# EasyEDA Pro project ProPrj_Starcat_FOC双路矢量控制器_2024-11-11.epro, schematic 14位磁编码_2
Create Date: 2024-03-02; Page Name: P1; Project Name: Starcat_FOC双路矢量控制器; Schematic Name: 14位磁编码; Update Date: 2024-03-02; Company: 嘉立创EDA; Page Size: A4; Version: V1.0
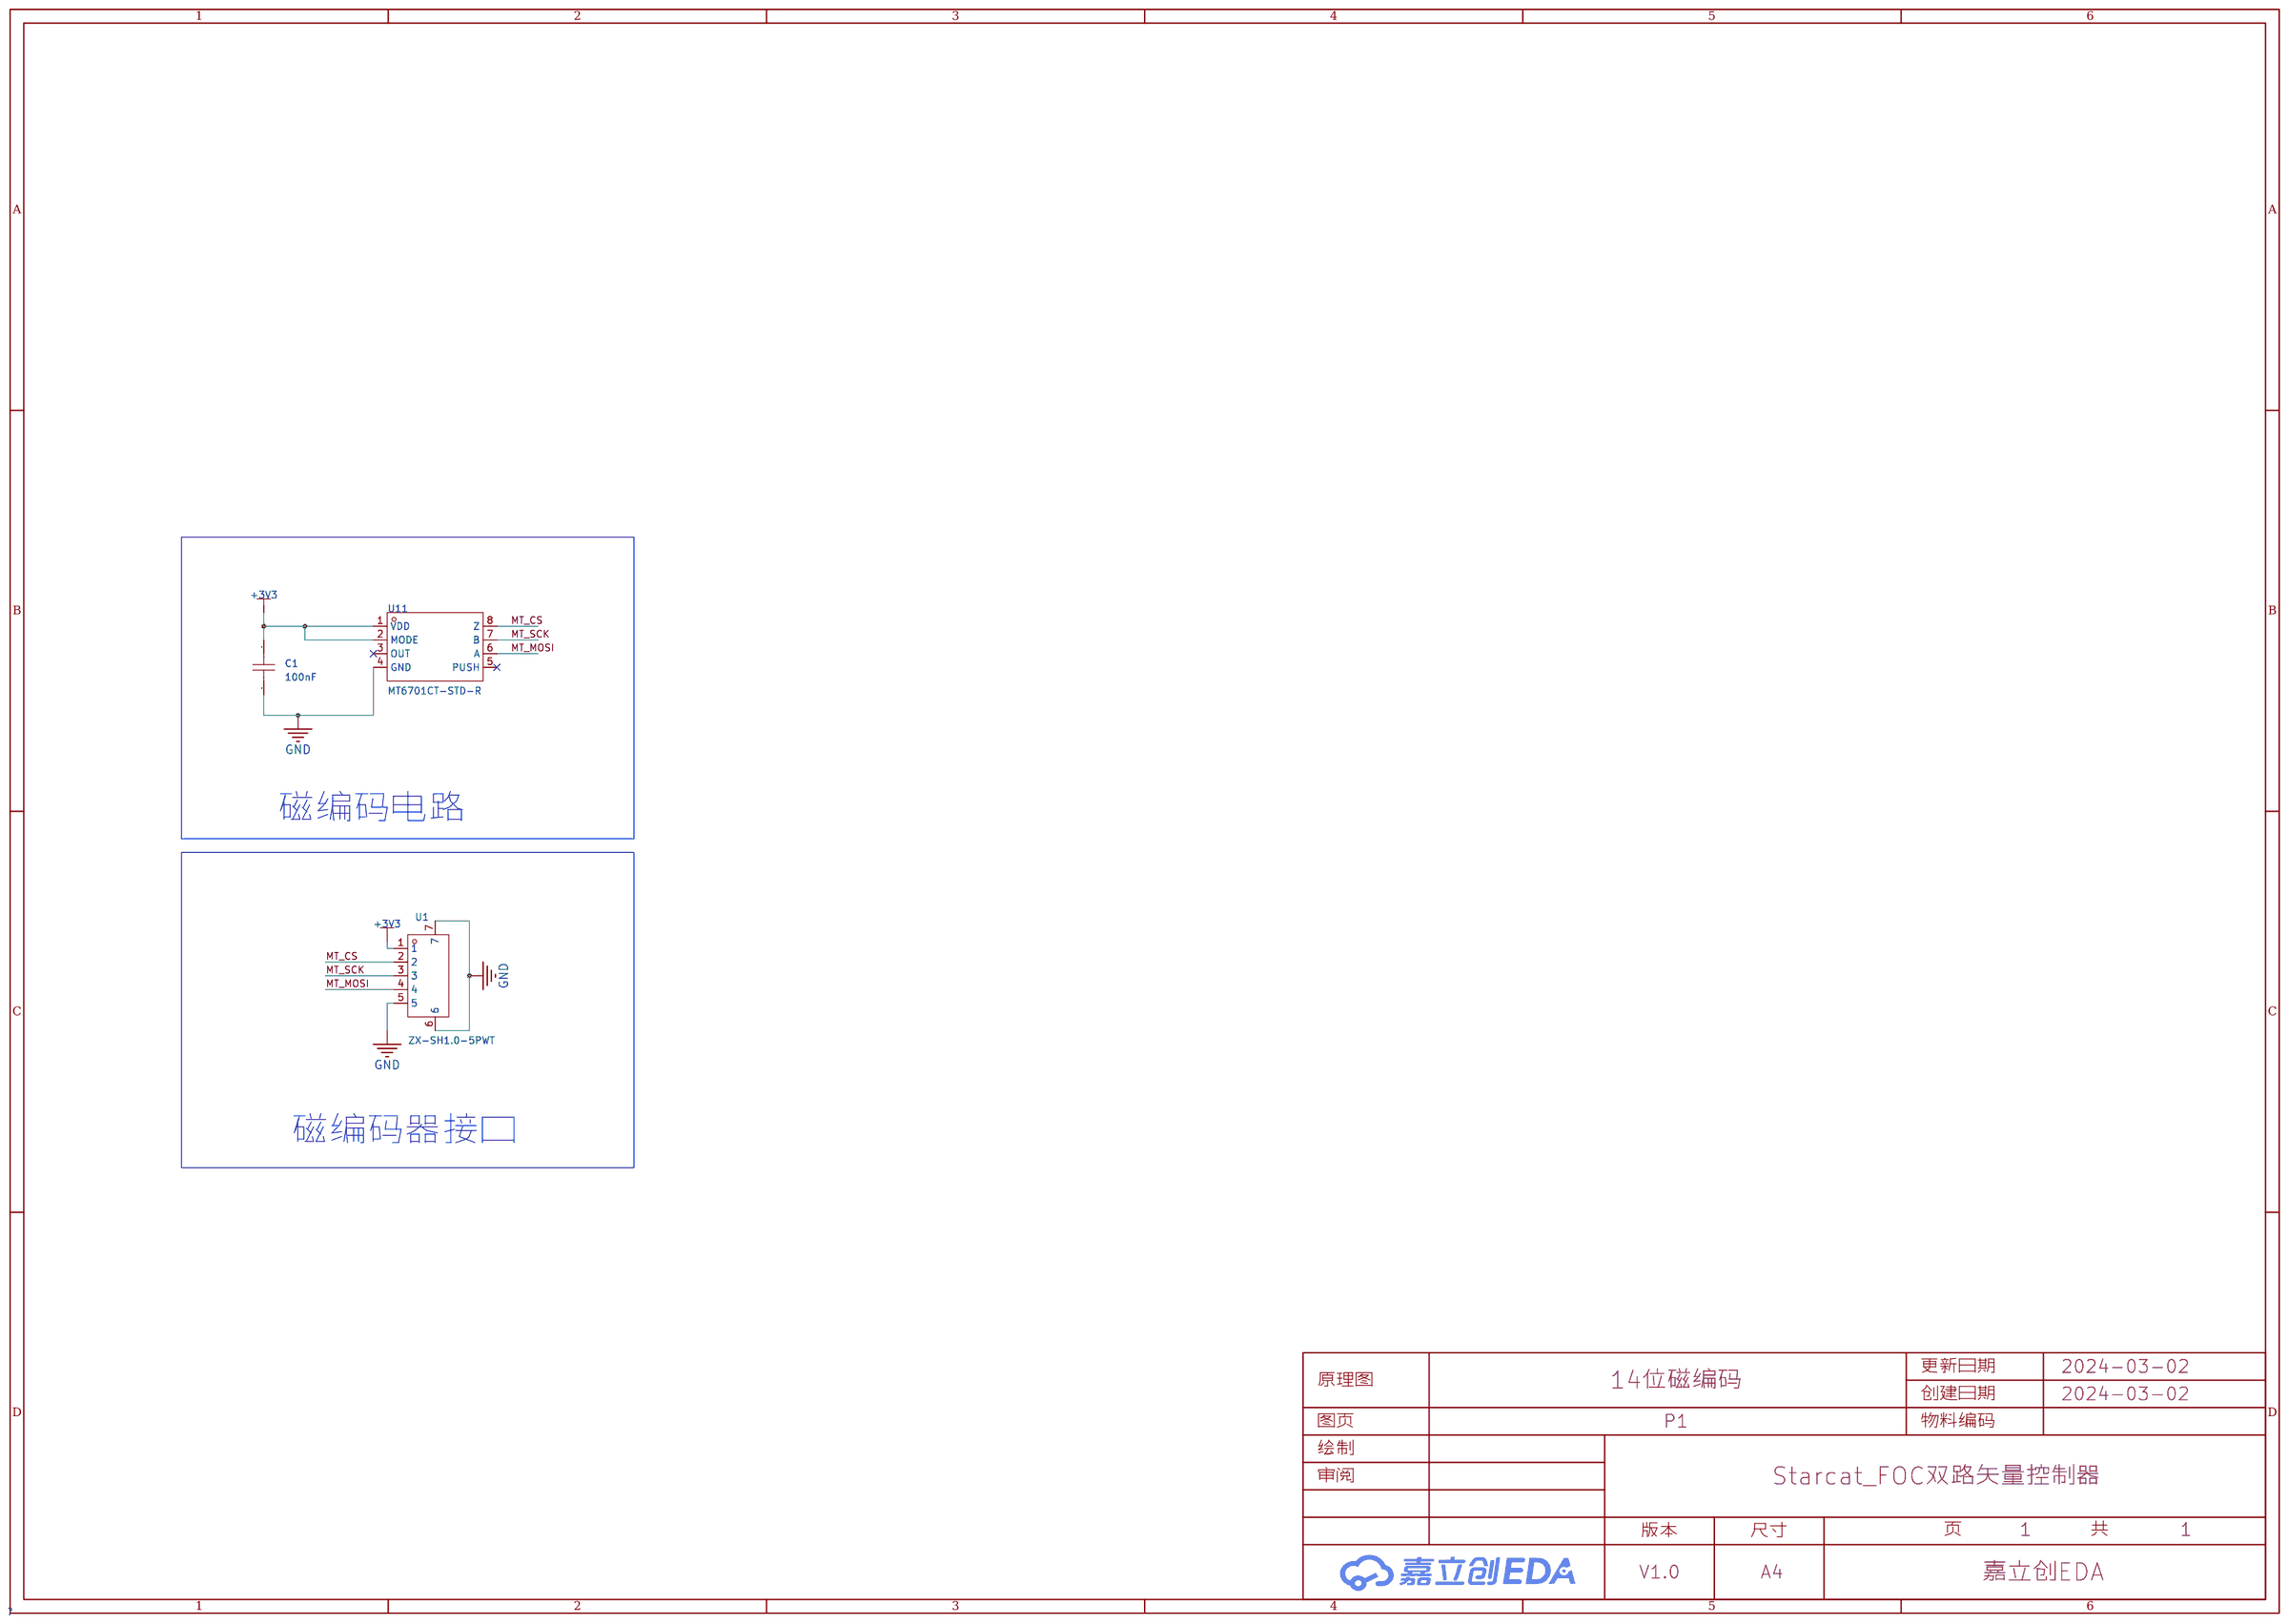
[diagram p0: schematic sheet]

## Parts
C1  100nF  [C0603]
U1  ZX-SH1.0-5PWT  [CONN-SMD_5P-P1.00_MEGASTAR_ZX-SH1.0-5PWT]
U11  MT6701CT-STD-R  [SOP-8_L4.9-W3.9-P1.27-LS6.0-BL]

## Library data of the parts
C1 = 0603B104K101NT: 容值:100nF;精度:±10%;额定电压:100V;材质(温度系数):X7R;; LCSC Part Name: 100nF ±10% 100V; Supplier Part: C88219; Manufacturer: FH(风华); Supplier Footprint: 0603; JLCPCB Part Class: 扩展库; Datasheet: https://atta.szlcsc.com/upload/public/pdf/source/20200305/C486355_26A10D38EF8C2A5C37091D0039909270.pdf; Supplier: LCSC; Tolerance: ±10%; Voltage Rated: 100V; Temperature Coefficient: X7R
U1 = ZX-SH1.0-5PWT: 插针结构:1x5P;间距:1mm;安装方式:卧贴;参考系列:SH;总PIN数:5P;排数:1;每排PIN数:5;行距:-;额定电流:1A;触头材质:黄铜;触头镀层:锡;工作温度范围:-25℃~+85℃;; Supplier Part: C7430447; Manufacturer: Megastar(兆星); Supplier Footprint: SMD,P=1mm,卧贴; JLCPCB Part Class: 扩展库; Datasheet: https://atta.szlcsc.com/upload/public/pdf/source/20230619/A00B60466F49A3581AA01BB47452619D.pdf; Supplier: LCSC; Pins Structure: 1x5P; Pitch: 1mm; Mounting Style: 卧贴; Reference Series: SH; Number of Pins: 5P; Number of Rows: 1; Number of PINs Per Row: 5; Current Rating (Max): 1A; Contact Material: 黄铜; Contact Plating: 锡; Operating Temperature Range: -25℃~+85℃
U11 = MT6701CT-STD-R: 霍尔在线编程角度位置传感器; LCSC Part Name: 霍尔在线编程角度位置传感器; Supplier Part: C3003196; Manufacturer: MagnTek(麦歌恩); Supplier Footprint: SOP-8; JLCPCB Part Class: 扩展库; Datasheet: https://atta.szlcsc.com/upload/public/pdf/source/20211029/3B38E099D06CBF231331F449427C995F.pdf; Supplier: LCSC

## Nets
+3V3: C1.1 U1.1 U11.1(VDD) U11.2(MODE)
GND: C1.2 U1.5 U1.6 U1.7 U11.4(GND)
MT_CS: U1.2 U11.8(Z)
MT_MOSI: U1.4 U11.6(A)
MT_SCK: U1.3 U11.7(B)

Not connected (* = marked no-connect by the designer): U11 3(OUT)* 5(PUSH)*

## Notes on the sheet
- 磁编码电路
- 磁编码器接口
